# EAGLE board MS14-N.v1.4 (EAGLE 7.5.0)
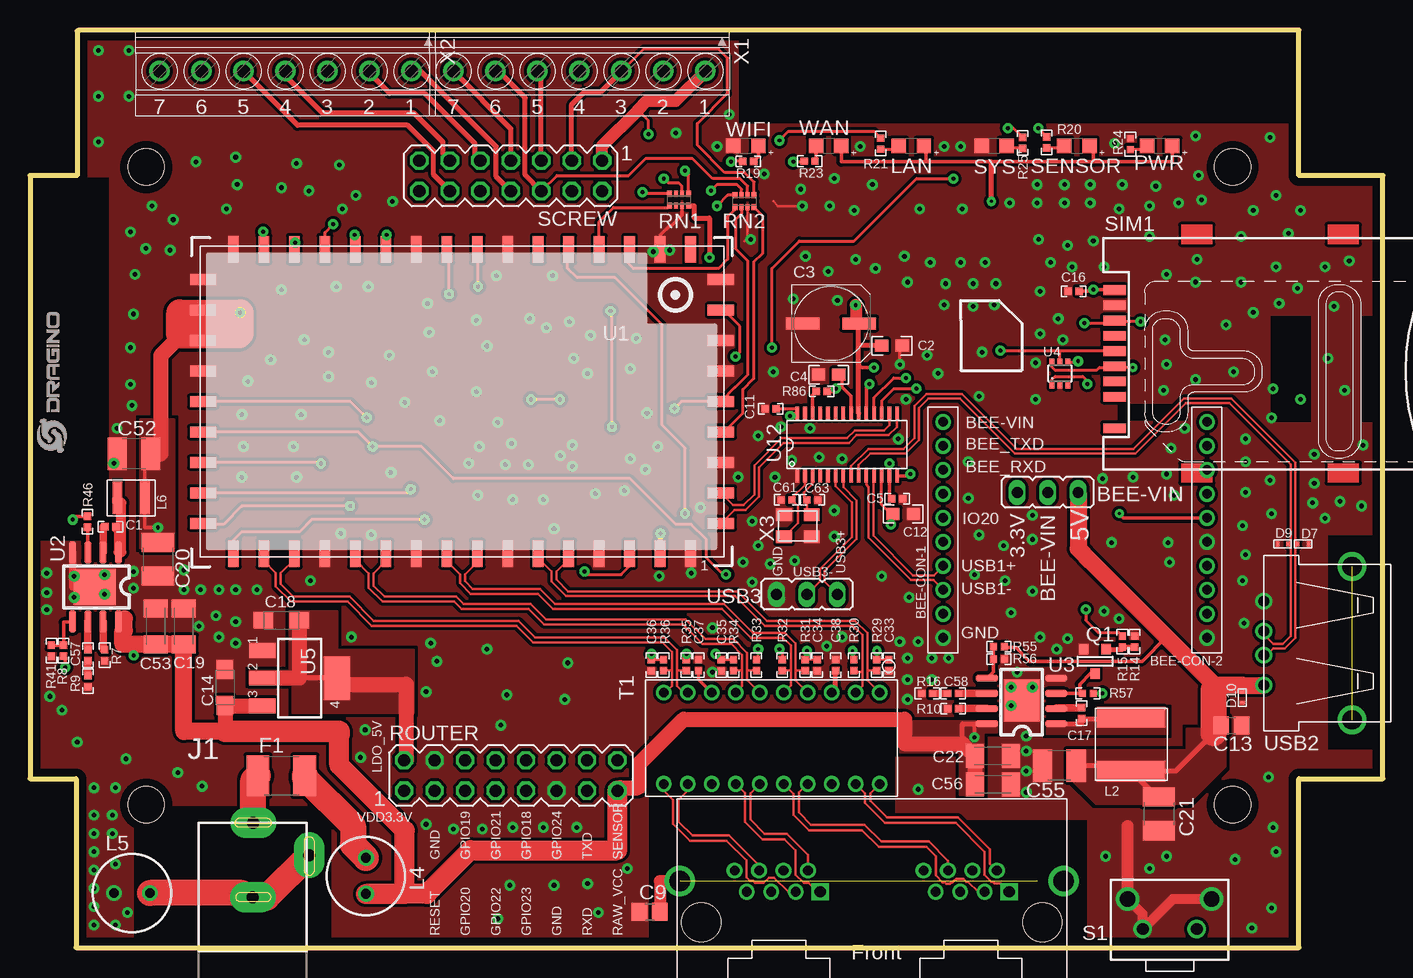
[diagram p5: board, top side]
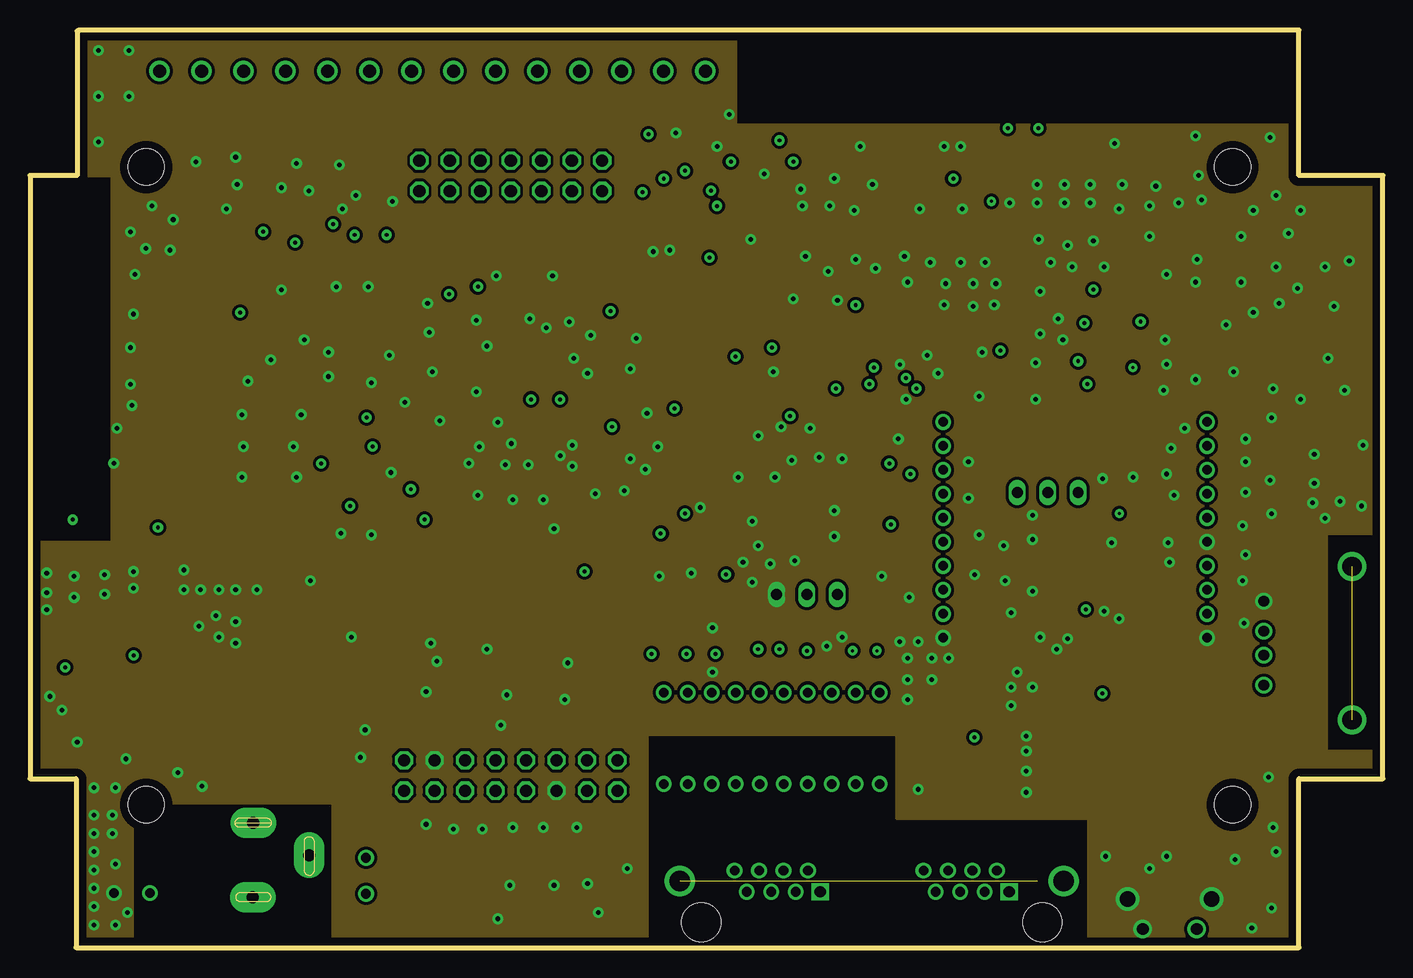
[diagram p6: board, inner layer Route2]
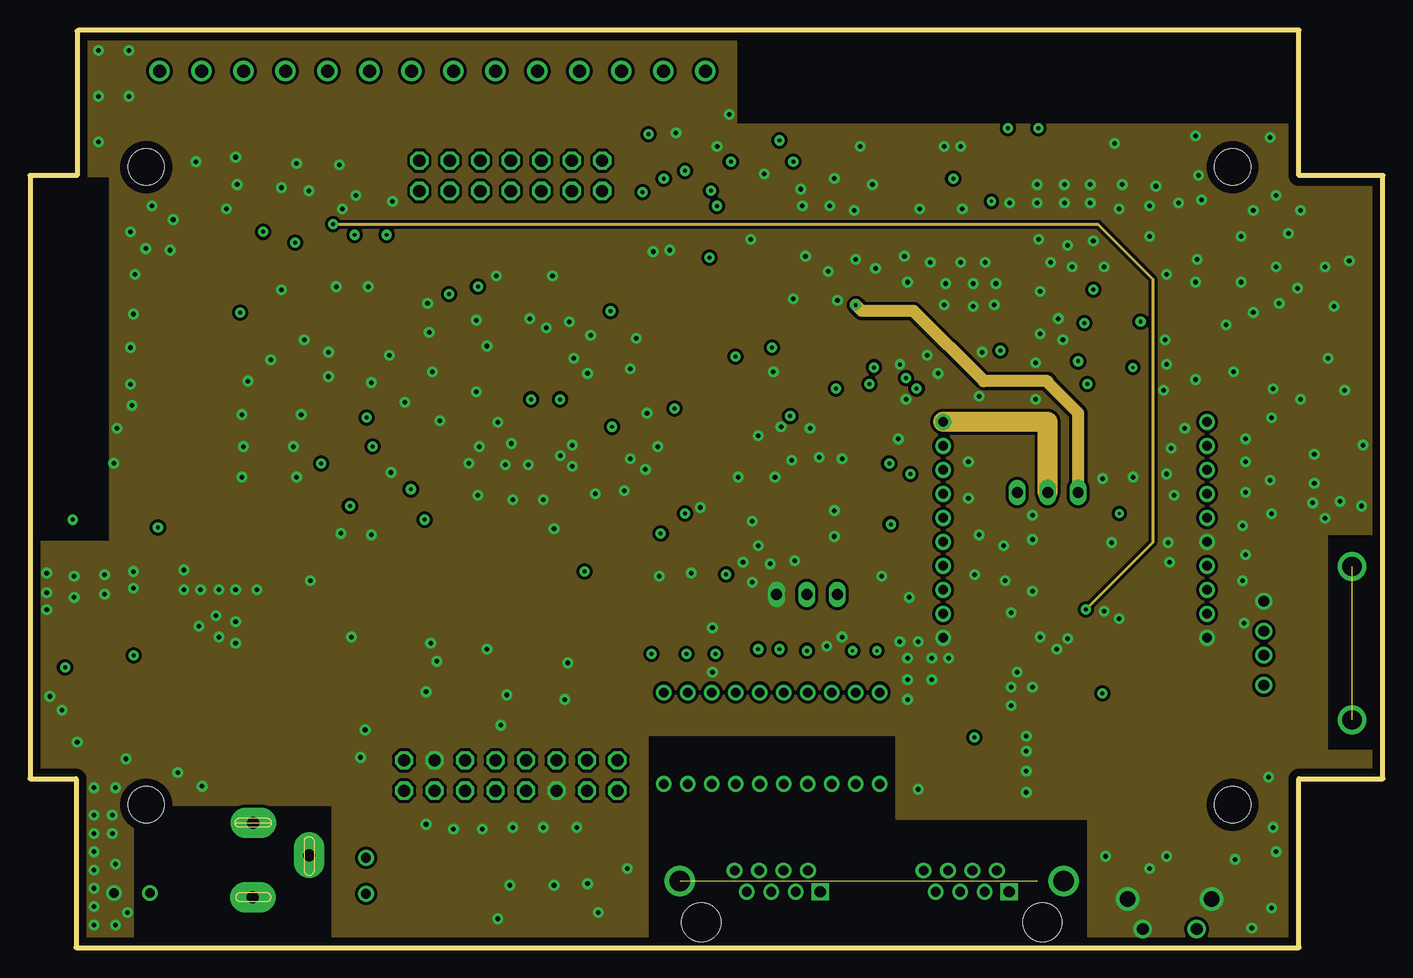
[diagram p7: board, inner layer Route15]
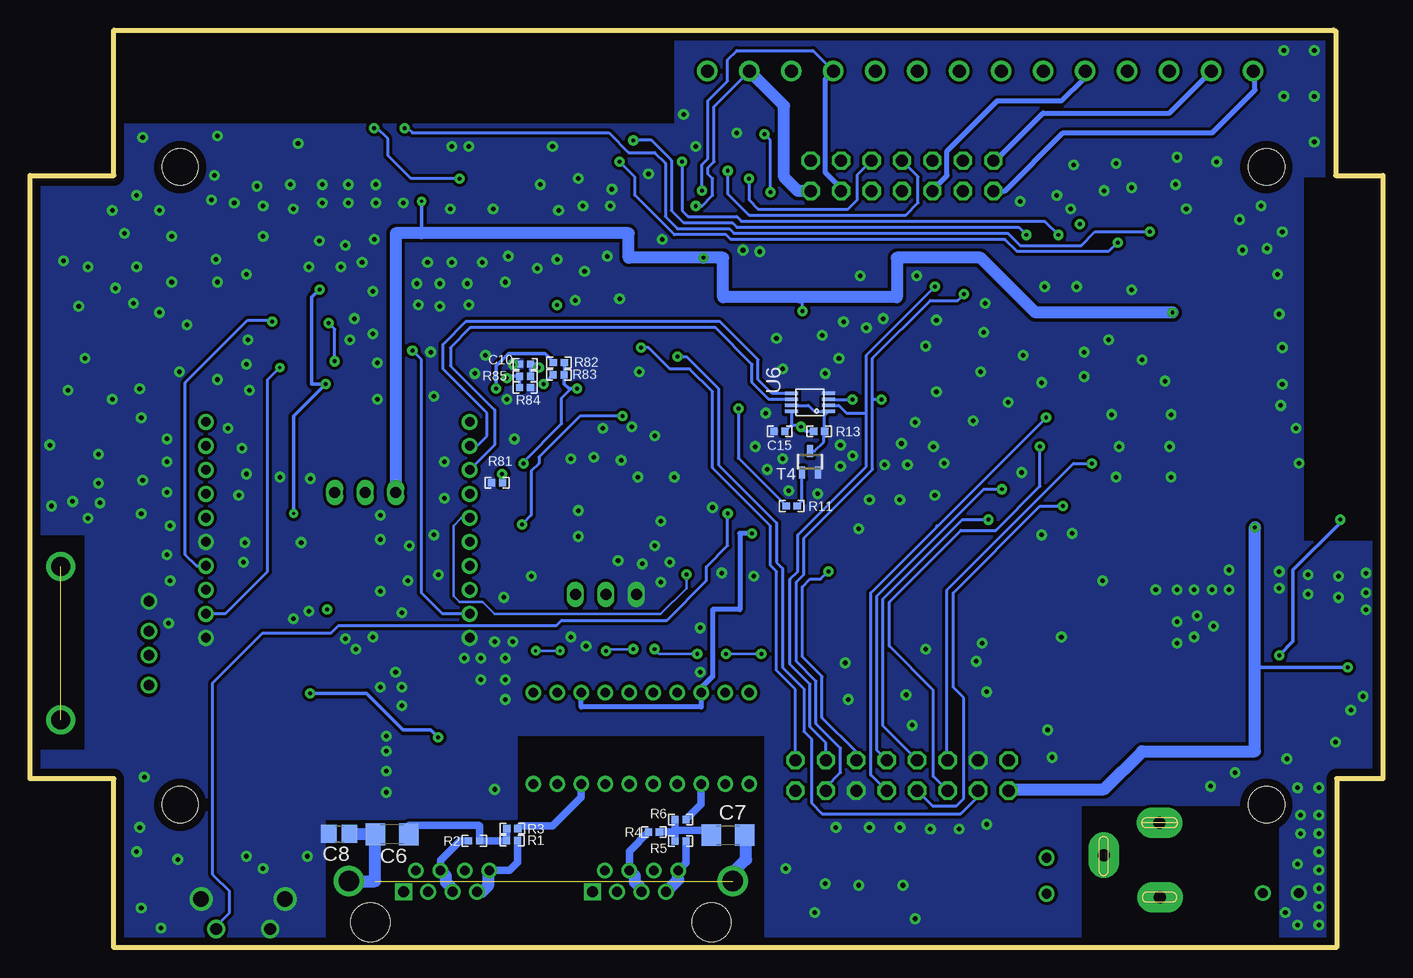
[diagram p8: board, bottom side, seen from below]

Size 112.78 x 76.5 mm. Coordinates in mm from the lower left corner, seen from the top.
Outline: 105.79,0 105.79,14.08 112.78,14.08 112.78,64.37 105.79,64.37 105.79,76.5 4.1,76.5 4.1,76.44 3.94,76.44 3.94,64.37 0,64.37 0,14.08 3.85,14.08 3.85,0 105.79,0
Copper layers (1*2+15*16): Top 0.035mm / dielectric 1.5mm / Route2 0.035mm / dielectric 0.15mm / Route15 0.035mm / dielectric 0.2mm / Bottom 0.035mm
Design rules "default *": minimum track width 5mil, minimum drill 10mil, track to track 8mil, track to pad 8mil, pad to pad 8mil, via to via 10mil, smd to smd 8mil, copper to edge 26mil, drill to drill 10mil, minimum pad ring 10mil, minimum via ring 10mil, stop-mask expansion 1mil, vias tented up to drill 30mil, thermal gap 10mil
Net classes: 0 default: width 0.203 mm, clearance 0.152 mm; 1 power: width 0.61 mm, drill 0.406 mm, clearance 0.254 mm; 2 gnd: width 0.305 mm, drill 0.33 mm, clearance 0.254 mm; 3 usbvcc: width 0.508 mm, drill 0.61 mm, clearance 0.254 mm; 4 aref: width 0.406 mm, drill 0.61 mm, clearance 0.254 mm; 6 usbtrace-4layer: width 0.191 mm, clearance 0.203 mm
Holes 3 mm at 100.25,11.91 9.7,11.91 9.7,65.08 100.25,65.08
bRestrict: area 98.9,70.3 to 105,75.9

## Footprints (pad centres in the part's own frame; a part is rotated, then mirrored left to right if it is on the bottom)
10P-2.0MM = drill 0.8 pad 1.27: 1 0,9; 2 0,7; 3 0,5; 4 0,3; 5 0,1; 6 0,-1; 7 0,-3; 8 0,-5; 9 0,-7; 10 0,-9
JP2 = drill 0.914 long: 1 -2.54,0; 2 0,0; 3 2.54,0
C0402 = smd 0.61 x 0.61: 1 -0.457,0; 2 0.457,0
C0603 = smd 1.1 x 1: 1 -0.85,0; 2 0.85,0
UD-6,3X5,8_NICHICON = smd 2.8 x 1: + 2.35,0; - -2.35,0
C1206 = smd 1.6 x 1.8: 1 -1.4,0; 2 1.4,0
C0805 = smd 1.3 x 1.5: 1 -0.85,0; 2 0.85,0
SMC_A = smd 1.6 x 1.4: + -1.5,0; - 1.5,0
C1206K = smd 1.5 x 2: 1 -1.5,0; 2 1.5,0
C1210 = smd 1.6 x 2.7: 1 -1.4,0; 2 1.4,0
SOD−923 = smd 0.3 x 0.4: P$1 -0.45,0; P$2 0.45,0
L1812 = smd 1.9 x 3.4: 1 -1.95,0; 2 1.95,0
POWER_JACK_SLOT = drill 1 pad 2.54 long: GND@1 0,0; GND@2 4.7,3.5; PWR 0.04,6.2
ETHERNET-1X2 = drill 0.94 pad 1.27 square: 1-1 4.305,-2.54; 2-1 -11.445,-2.54 | drill 0.8: 1-2 5.325,-4.32; 1-3 6.345,-2.54; 1-4 7.365,-4.32; 1-5 8.385,-2.54; 1-6 9.405,-4.32; 1-7 10.425,-2.54; 1-8 11.445,-4.32; 2-2 -10.425,-4.32; 2-3 -9.405,-2.54; 2-4 -8.385,-4.32; 2-5 -7.365,-2.54; 2-6 -6.345,-4.32; 2-7 -5.325,-2.54; 2-8 -4.305,-4.32 | drill 1.7: S1 16,-3.43; S2 -16,-3.43 | hole 3.25: -14.225,0; 14.225,0
SWPA6028S = smd 5.7 x 1.7: P$1 0,2.25; P$2 0,-2.25
BS11 = drill 0.8: 1 -1.5,0; 2 1.5,0
SWPA3010S = smd 0.8 x 2.7: P$1 -1.15,0; P$2 1.15,0
CHIP-LED0805 = smd 1.2 x 1.2: A 0,-1.05; C 0,1.05
SOT-23 = smd 0.787 x 0.889: 1 0,-1.016; 2 -0.95,1.016; 3 0.95,1.016
R0402 = smd 0.61 x 0.61: 1 -0.457,0; 2 0.457,0
4X0402ARV341 = smd 0.4 x 0.5: 1 -0.8,-0.5; 4 0.8,-0.5; 5 0.8,0.5; 8 -0.8,0.5 | smd 0.3 x 0.5: 2 -0.25,-0.5; 3 0.25,-0.5; 6 0.25,0.5; 7 -0.25,0.5
MA08-2 = drill 1.016 octagon: 1 -8.89,-1.27; 2 -8.89,1.27; 3 -6.35,-1.27; 4 -6.35,1.27; 5 -3.81,-1.27; 6 -3.81,1.27; 7 -1.27,-1.27; 8 -1.27,1.27; 9 1.27,-1.27; 10 1.27,1.27; 11 3.81,-1.27; 12 3.81,1.27; 13 6.35,-1.27; 14 6.35,1.27; 15 8.89,-1.27; 16 8.89,1.27
SWITCH_6X6X5 = drill 0.991 pad 1.524: 1 -2.25,0; 2 2.25,0 | drill 1.295 pad 1.905: 3 3.5,2.5; 4 -3.5,2.5
MA07-2 = drill 1.016 octagon: 1 -7.62,-1.27; 2 -7.62,1.27; 3 -5.08,-1.27; 4 -5.08,1.27; 5 -2.54,-1.27; 6 -2.54,1.27; 7 0,-1.27; 8 0,1.27; 9 2.54,-1.27; 10 2.54,1.27; 11 5.08,-1.27; 12 5.08,1.27; 13 7.62,-1.27; 14 7.62,1.27
SIM-0002 = smd 0.8 x 1.9: C1 5.3,19.05; C2 2.76,19.05; C3 0.22,19.05; C4 -2.32,19.05; C5 4.03,19.05; C6 1.49,19.05; C7 -1.05,19.05; C8 -3.59,19.05; C9 -6.21,19.05
RIONET_H2038 = drill 0.8: 1 -3.81,9; 2 -3.81,7; 3 -3.81,5; 4 -3.81,3; 5 -3.81,1; 6 -3.81,-1; 7 -3.81,-3; 8 -3.81,-5; 9 -3.81,-7; 10 -3.81,-9; 11 3.81,-9; 12 3.81,-7; 13 3.81,-5; 14 3.81,-3; 15 3.81,-1; 16 3.81,1; 17 3.81,3; 18 3.81,5; 19 3.81,7; 20 3.81,9
SOT323 = smd 0.5 x 1: 1 0,0.9; 2 -0.65,-0.9; 3 0.65,-0.9
HE50 = smd 0.9 x 2.198: 1 -19.05,12.69; 2 -16.51,12.69; 3 -13.97,12.69; 4 -11.43,12.69; 5 -8.89,12.69; 6 -6.35,12.69; 7 -3.81,12.69; 8 -1.27,12.69; 9 1.27,12.69; 10 3.81,12.69; 11 6.35,12.69; 12 8.89,12.69; 13 11.43,12.69; 14 13.97,12.69; 15 16.51,12.69; 16 19.05,12.69; 26 19.05,-12.69; 27 16.51,-12.69; 28 13.97,-12.69; 29 11.43,-12.69; 30 8.89,-12.69; 31 6.35,-12.69; 32 3.81,-12.69; 33 1.27,-12.69; 34 -1.27,-12.69; 35 -3.81,-12.69; 36 -6.35,-12.69; 37 -8.89,-12.69; 38 -11.43,-12.69; 39 -13.97,-12.69; 40 -16.51,-12.69; 41 -19.05,-12.69 | smd 2.198 x 0.9: 17 21.579,10.16; 18 21.579,7.62; 19 21.579,5.08; 20 21.579,2.54; 21 21.579,0; 22 21.579,-2.54; 23 21.579,-5.08; 24 21.579,-7.62; 25 21.579,-10.16; 42 -21.579,-10.16; 43 -21.579,-7.62; 44 -21.579,-5.08; 45 -21.579,-2.54; 46 -21.579,0; 47 -21.579,2.54; 48 -21.579,5.08; 49 -21.579,7.62; 50 -21.579,10.16
RT8250-SOP8 = smd 1.88 x 0.61: 1 -1.219,0; 2 -1.219,-1.27; 3 -1.219,-2.54; 4 -1.219,-3.81; 5 4.547,-3.81; 6 4.547,-2.54; 7 4.547,-1.27; 8 4.547,0 | smd 2.997 x 3.505: 9 1.651,-1.956
SOT363 = smd 0.42 x 0.6: 1 -0.65,-0.95; 2 0,-0.95; 3 0.65,-0.95; 4 0.65,0.95; 5 0,0.95; 6 -0.65,0.95
SOT223 = smd 1.219 x 2.235: 1 -2.311,-3.099; 2 0,-3.099; 3 2.311,-3.099 | smd 3.6 x 2.2: 4 0,3.099
US8 = smd 0.3 x 1.1: 1 -0.75,-1.55; 2 -0.25,-1.55; 3 0.25,-1.55; 4 0.75,-1.55; 5 0.75,1.55; 6 0.25,1.55; 7 -0.25,1.55; 8 -0.75,1.55
USB_HUB_FE1.1S = smd 0.3 x 1.1: 1 -4.16,-2.6; 2 -3.52,-2.6; 3 -2.88,-2.6; 4 -2.24,-2.6; 5 -1.6,-2.6; 6 -0.96,-2.6; 7 -0.32,-2.6; 8 0.32,-2.6; 9 0.96,-2.6; 10 1.6,-2.6; 11 2.24,-2.6; 12 2.88,-2.6; 13 3.52,-2.6; 14 4.16,-2.6; 15 4.16,2.62; 16 3.52,2.62; 17 2.88,2.62; 18 2.24,2.62; 19 1.6,2.62; 20 0.96,2.62; 21 0.32,2.62; 22 -0.32,2.62; 23 -0.96,2.62; 24 -1.6,2.62; 25 -2.24,2.62; 26 -2.88,2.62; 27 -3.52,2.62; 28 -4.16,2.62
USB_C42562 = drill 0.9: 1 -3.5,5.29; 2 -1,5.29; 3 1,5.29; 4 3.5,5.29 | drill 1.6: 5 -6.4,-2.06; 6 6.4,-2.06
1751293 = drill 1.1 pad 1.7: 1 -10.5,-0.1; 2 -7,-0.1; 3 -3.5,-0.1; 4 0,-0.1; 5 3.5,-0.1; 6 7,-0.1; 7 10.5,-0.1
SMARTPRJ_CRYSTAL-3.2-2.5 = smd 1.3 x 1.05: 1 -1.15,-0.925; 2 1.15,-0.925; 3 1.15,0.925; 4 -1.15,0.925

## Placement (x,y rotation side)
BEE-CON-1  BEE-1  [10P-2.0MM]  76.12,34.82 0 top
BEE-CON-2  BEE-1  [10P-2.0MM]  98.12,34.82 180 top
BEE-VIN  1x3 , 2.54 弯针  [JP2]  84.84,37.96 0 top
C1  0.1u,50v  [C0402]  6.71,35.08 0 top
C2  10uf 10v  [C0603]  71.86,50.17 0 top
C3  100uF 16v TBD  [UD-6,3X5,8_NICHICON]  66.78,52.03 0 top
C4  10uf 10v  [C0603]  66.57,47.76 180 top
C5  0.1u  [C0402]  72.29,37.42 0 top
C6  1000pF,2kv  [C1206]  82.59,9.44 180 bottom
C7  1000pF,2kv  [C1206]  54.59,9.37 0 bottom
C8  0.1u,100V  [C0805]  87,9.48 0 bottom
C9  0.1u,100V  [C0805]  51.67,2.97 0 top
C10  0.1u  [C0402]  71.5,48.65 180 bottom
C11  0.1u  [C0402]  61.75,44.91 180 top
C12  10uf 10v  [C0603]  72.8,36.15 0 top
C13  10u,10V  [C0805]  100.15,18.52 0 top
C14  10uF,10V  [SMC_A]  16.26,21.7 90 top
C15  0.1u  [C0402]  50.29,43.04 180 bottom
C16  0.1u  [C0402]  87,54.72 0 top
C17  0.1u,50v  [C0402]  87.66,19.54 270 top
C18  10uF,10V  [SMC_A]  20.95,27.29 180 top
C19  10uf,50v  [C1206K]  12.83,26.78 90 top
C20  22uF,10v  [C1210]  10.67,32.37 270 top
C21  22uf,10v  [C1210]  94.11,11.16 270 top
C22  10uf,50v  [C1206K]  80.26,15.98 0 top
C33  0.1u 10v  [C0402]  71.6,23.55 270 top
C34  0.1u 10v  [C0402]  65.64,23.55 270 top
C35  0.1u 10v  [C0402]  57.63,23.55 270 top
C36  0.1u 10v  [C0402]  51.79,23.55 270 top
C37  0.1u  [C0402]  55.73,23.55 90 top
C38  0.1u  [C0402]  67.16,23.55 90 top
C52  22uF,10v  [C1210]  8.66,41.16 180 top
C53  10uf,50v  [C1206K]  10.46,26.78 90 top
C55  22fu,10v  [C1210]  85.8,15.17 180 top
C56  10uf,50v  [C1206K]  80.29,13.6 0 top
C57  2.7nf  [C0402]  4.83,24.37 90 top
C58  2.7nf  [C0402]  76.96,21.19 0 top
C61  18pF  [C0402]  63.07,37.32 0 top
C63  18pF  [C0402]  65.23,37.32 180 top
D7  ESD7951ST5G  [SOD−923]  106.12,33.64 180 top
D9  ESD7951ST5G  [SOD−923]  104.44,33.64 0 top
D10  ESD7951ST5G  [SOD−923]  101.07,20.86 90 top
F1  2A  [L1812]  20.95,14.33 0 top
J1  POWER_JACKSLT  [POWER_JACK_SLOT]  18.58,4.21 0 top
J2  ETHERNET_2PORT  [ETHERNET-1X2]  70.18,2.1 180 top
L2  6.8uH / SWPA6045S6R8MT  [SWPA6028S]  91.8,16.95 0 top
L4  bead  [BS11]  28.02,5.98 90 top
L5  bead  [BS11]  8.51,4.55 0 top
L6  4.7uH /SWPA3015S4R7MT  [SWPA3010S]  8.43,37.5 0 top
LAN  GREEN  [CHIP-LED0805]  73.47,66.84 90 top
PWR  GREEN  [CHIP-LED0805]  94.17,66.84 90 top
Q1  BSS138-7-F  [SOT-23]  88.77,23.86 0 top
R1  75  [R0402]  72.59,8.91 0 bottom
R2  75  [R0402]  75.75,8.9 180 bottom
R3  75  [R0402]  72.57,9.91 180 bottom
R4  75  [R0402]  60.76,9.63 180 bottom
R5  75  [R0402]  58.55,8.87 0 bottom
R6  75  [R0402]  58.55,10.67 180 bottom
R7  180K  [R0402]  6.22,24.37 270 top
R8  75K 1%  [R0402]  2.79,24.75 270 top
R9  16K 1%  [R0402]  4.83,22.21 90 top
R10  180K  [R0402]  76.96,19.92 180 top
R11  4.7K  [R0402]  49.28,36.81 180 bottom
R13  100K  [R0402]  46.99,43.04 180 bottom
R14  47K,NL  [R0402]  92.08,25.51 270 top
R15  4.7k  [R0402]  91.06,25.51 270 top
R16  24K  [R0402]  74.8,21.19 180 top
R19  270  [R0402]  59.87,65.54 0 top
R20  330  [R0402]  84.74,67.14 270 top
R21  330  [R0402]  70.93,67.03 270 top
R23  330  [R0402]  64.99,65.56 0 top
R24  330  [R0402]  91.73,66.98 270 top
R25  270  [R0402]  82.75,67.09 270 top
R29  49.9  [R0402]  70.59,23.55 90 top
R30  49.9  [R0402]  68.68,23.55 90 top
R31  49.9  [R0402]  64.62,23.55 90 top
R32  49.9  [R0402]  62.71,23.55 90 top
R33  49.9  [R0402]  60.56,23.55 90 top
R34  49.9  [R0402]  58.65,23.55 90 top
R35  49.9  [R0402]  54.71,23.55 90 top
R36  49.9  [R0402]  52.81,23.55 90 top
R41  24K 1%  [R0402]  1.78,24.75 90 top
R46  100K  [R0402]  4.8,35.49 270 top
R55  53.6K 1%  [R0402]  80.77,25.08 0 top
R56  10K 1%  [R0402]  80.77,24.04 180 top
R57  100K  [R0402]  88.19,21.19 0 top
R81  2.7K 1%  [R0402]  73.84,38.74 0 bottom
R82  100k  [R0402]  68.68,48.78 0 bottom
R83  100k  [R0402]  68.71,47.76 0 bottom
R84  100k  [R0402]  71.5,46.69 180 bottom
R85  47K  [R0402]  71.5,47.63 0 bottom
R86  100k  [R0402]  65.99,46.36 0 top
RN1  4D02WGJ0000TCE 0ohm , NL  [4X0402ARV341]  54.1,62.34 0 top
RN2  4D02WGJ0000TCE 0ohm , NL  [4X0402ARV341]  59.56,62.21 0 top
ROUTER  [MA08-2]  40.08,14.34 0 top
S1  [SWITCH_6X6X5]  95.01,1.54 0 top
SCREW  [MA07-2]  40.08,64.34 180 top
SENSOR  GREEN  [CHIP-LED0805]  87.27,66.84 90 top
SIM1  SIM_CARD_CON_8JISEN,NL  [SIM-0002]  109.47,49.51 90 top
SYS  GREEN  [CHIP-LED0805]  80.37,66.84 90 top
T1  RJ45_TRANSFORMER_HST2038DR  [RIONET_H2038]  61.83,17.45 270 top
T4  2SC4081/SC70  [SOT323]  47.75,40.5 0 bottom
U1  HE  [HE50]  36.02,45.52 180 top
U2  RT7272  [RT8250-SOP8]  7.37,31.73 270 top
U3  RT7272  [RT8250-SOP8]  84.33,18.65 180 top
U4  SMF05C,NL  [SOT363]  85.85,47.86 0 top
U5  BL1117-50CX  [SOT223]  22.48,22.46 270 top
U6  NC7WZ125  [US8]  47.75,45.45 90 bottom
U12  USB_HUB_FE1.1S  [USB_HUB_FE1.1S]  68.12,41.92 0 top
U$2  [SMA-JACK]  6.99,18.52 270 top
U$6  [SMA-JACK]  6.99,59.16 270 top
U$7  [SMA-JACK]  6.99,44.56 180 top
U$8  [SMA-JACK]  6.99,40.11 270 top
U$10  [SMA-JACK]  40,7.09 0 top
U$11  [LOGO-SILK-NEW]  3.05,41.26 90 top
USB2  USB_C42562  [USB_C42562]  108.15,25.37 90 top
USB3  1x3 , 2.54 排母  [JP2]  64.77,29.45 0 top
WAN  GREEN  [CHIP-LED0805]  66.58,66.84 90 top
WIFI  GREEN  [CHIP-LED0805]  59.68,66.84 90 top
X1  1751293  [1751293]  45.8,72.97 180 top
X2  1751293  [1751293]  21.3,72.97 180 top
X3  12Mhz,X322512MMB4SI  [SMARTPRJ_CRYSTAL-3.2-2.5]  64.01,35.16 180 top

## Tracks (layer width: path | path; a pad name or v marks a point on that pad's centre or on a via)
2.0V_CTL  (via drill 0.33)
  Top 0.305: C37.1 55.73,22.36 T1.8
  Top 0.406: U1.2 52.58,32.84 v52.58,34.53 | T1.3 67.16,21.26 C38.1
  Bottom 0.406: v52.58,34.53 53.59,34.53 53.59,28.18 55.88,28.18 55.88,22.59 56.83,21.64 T1.8 56.83,20.05 66.83,20.05 T1.3
5V_LDO
  Top 0.406: U5.4 22.23,22.46
  Top 1.27: U5.2 22.23,22.46 22.48,22.46 22.48,27.29 C18.+ | U5.4 25.58,21.95 31.37,21.95 31.37,15.61 ROUTER.2
  pour Top (no thermals): 21.59,28.05 25.65,28.05 25.65,24.87 32,24.87 32,19.54 21.84,19.54 21.84,21.95 18.29,21.95 18.29,23.1 21.59,23.1
+3V3  (via drill 0.25, 0.33)
  Top 0.254: v48.51,43.42 48.51,52.94 v48.39,53.07 | 14.61,51.42 14.61,50.77 U1.23
  Top 0.305: PWR.A 95.22,65.51 88.65,65.51 | 88.65,65.51 80.14,65.51 74.68,65.51 | 74.68,65.51 67.63,65.51 WAN.A | LAN.A 74.68,66.84 74.68,65.51 | C20.1 v10.67,35.03 9.58,35.03 L6.P$2 9.58,42.43 | R8.2 2.92,24.29 v2.92,23.35 | SENSOR.A 88.65,66.84 88.65,65.51
  Top 0.406: RN1.4 55.37,61.84 55.37,60.82 56.64,60.82 v56.64,57.51 | v80.14,62.21 80.14,65.51
  Top 0.61: 14.22,51.8 14.44,52.01 U1.24
  Top 1.27: C52.1 10.92,41.16 10.92,49.39 12.57,51.04 13.84,51.04 | U1.23 14.87,51.04 14.99,51.04
  Top 2.184: 14.61,51.42 14.22,51.8 | 12.45,51.04 12.45,52.94 v17.53,52.94 17.53,51.16 17.4,51.04 14.99,51.04 13.84,51.04 12.45,51.04
  Bottom 0.254: U6.8 49.3,43.57 | 49.3,43.57 C15.1 | R13.2 48.13,43.04 v48.51,43.42 48.67,43.57 49.3,43.57 | v48.39,53.07 48.39,53.96 48.64,54.21
  Bottom 0.305: v80.14,62.21 80.14,59.55 | 10.67,28.94 v10.67,35.03 | v2.92,23.35 10.67,23.35 10.67,23.48
  Bottom 1.016: ROUTER.1 31.07,13.19 23.24,13.19 20.07,16.37 10.67,16.37 10.67,23.48 v10.67,35.03 | v17.53,52.94 28.96,52.94 33.53,57.51 40.51,57.51 40.51,54.21 48.64,54.21 54.99,54.21 54.99,57.51 v56.64,57.51 62.86,57.51 62.86,59.55 80.14,59.55 82.3,59.55 BEE-VIN.1
  pour Top (no thermals): 9.14,33.26 12.07,33.26 12.07,44.05 9.14,44.05
+5V  (via drill 0.33)
  Top 0.254: C13.1 99.19,18.52 98.68,19.03 | 91.69,28.18 92.46,28.18
  Top 0.305: 69.23,51.93 C3.+ | v70.36,48.37 69.34,48.37 69.08,48.62 | D10.P$2 101.07,21.87 101.09,21.87 | 88.33,32.18 88.45,32.18 | 94.74,25.89 92.71,23.86 83.31,23.86 82.17,25 81.31,25 R55.2
  Top 0.406: U12.20 69.08,48.62 69.08,50.27 | 69.08,50.27 69.08,51.98 C3.+ | C2.1 69.18,50.17 69.08,50.27 | C55.1 91.8,15.17 L2.P$2 | 98.68,17.89 95.49,14.7 L2.P$2 | L2.P$2 93.94,12.56 C21.1
  Top 1.016: v68.83,53.58 68.83,52.32 C3.+
  Top 1.422: USB2.1 101.09,21.87 99.11,21.87 98.93,21.7 | 98.93,21.7 98.68,21.45 | BEE-VIN.3 87.38,33.26 88.45,32.18 92.46,28.18 94.74,25.89 98.93,21.7
  Top 2.184: 98.68,17.89 98.68,19.03 98.68,21.45
  Route15 1.016: BEE-VIN.3 87.38,44.56 84.71,47.23 | 84.84,47.23 84.71,47.23 | 84.71,47.23 79.5,47.23 73.66,53.07 69.34,53.07 v68.83,53.58